# EasyEDA Pro project ProProject_IMUSensorNodes202312.epro, board 6_6_拼板20240123（带编号） (continued)
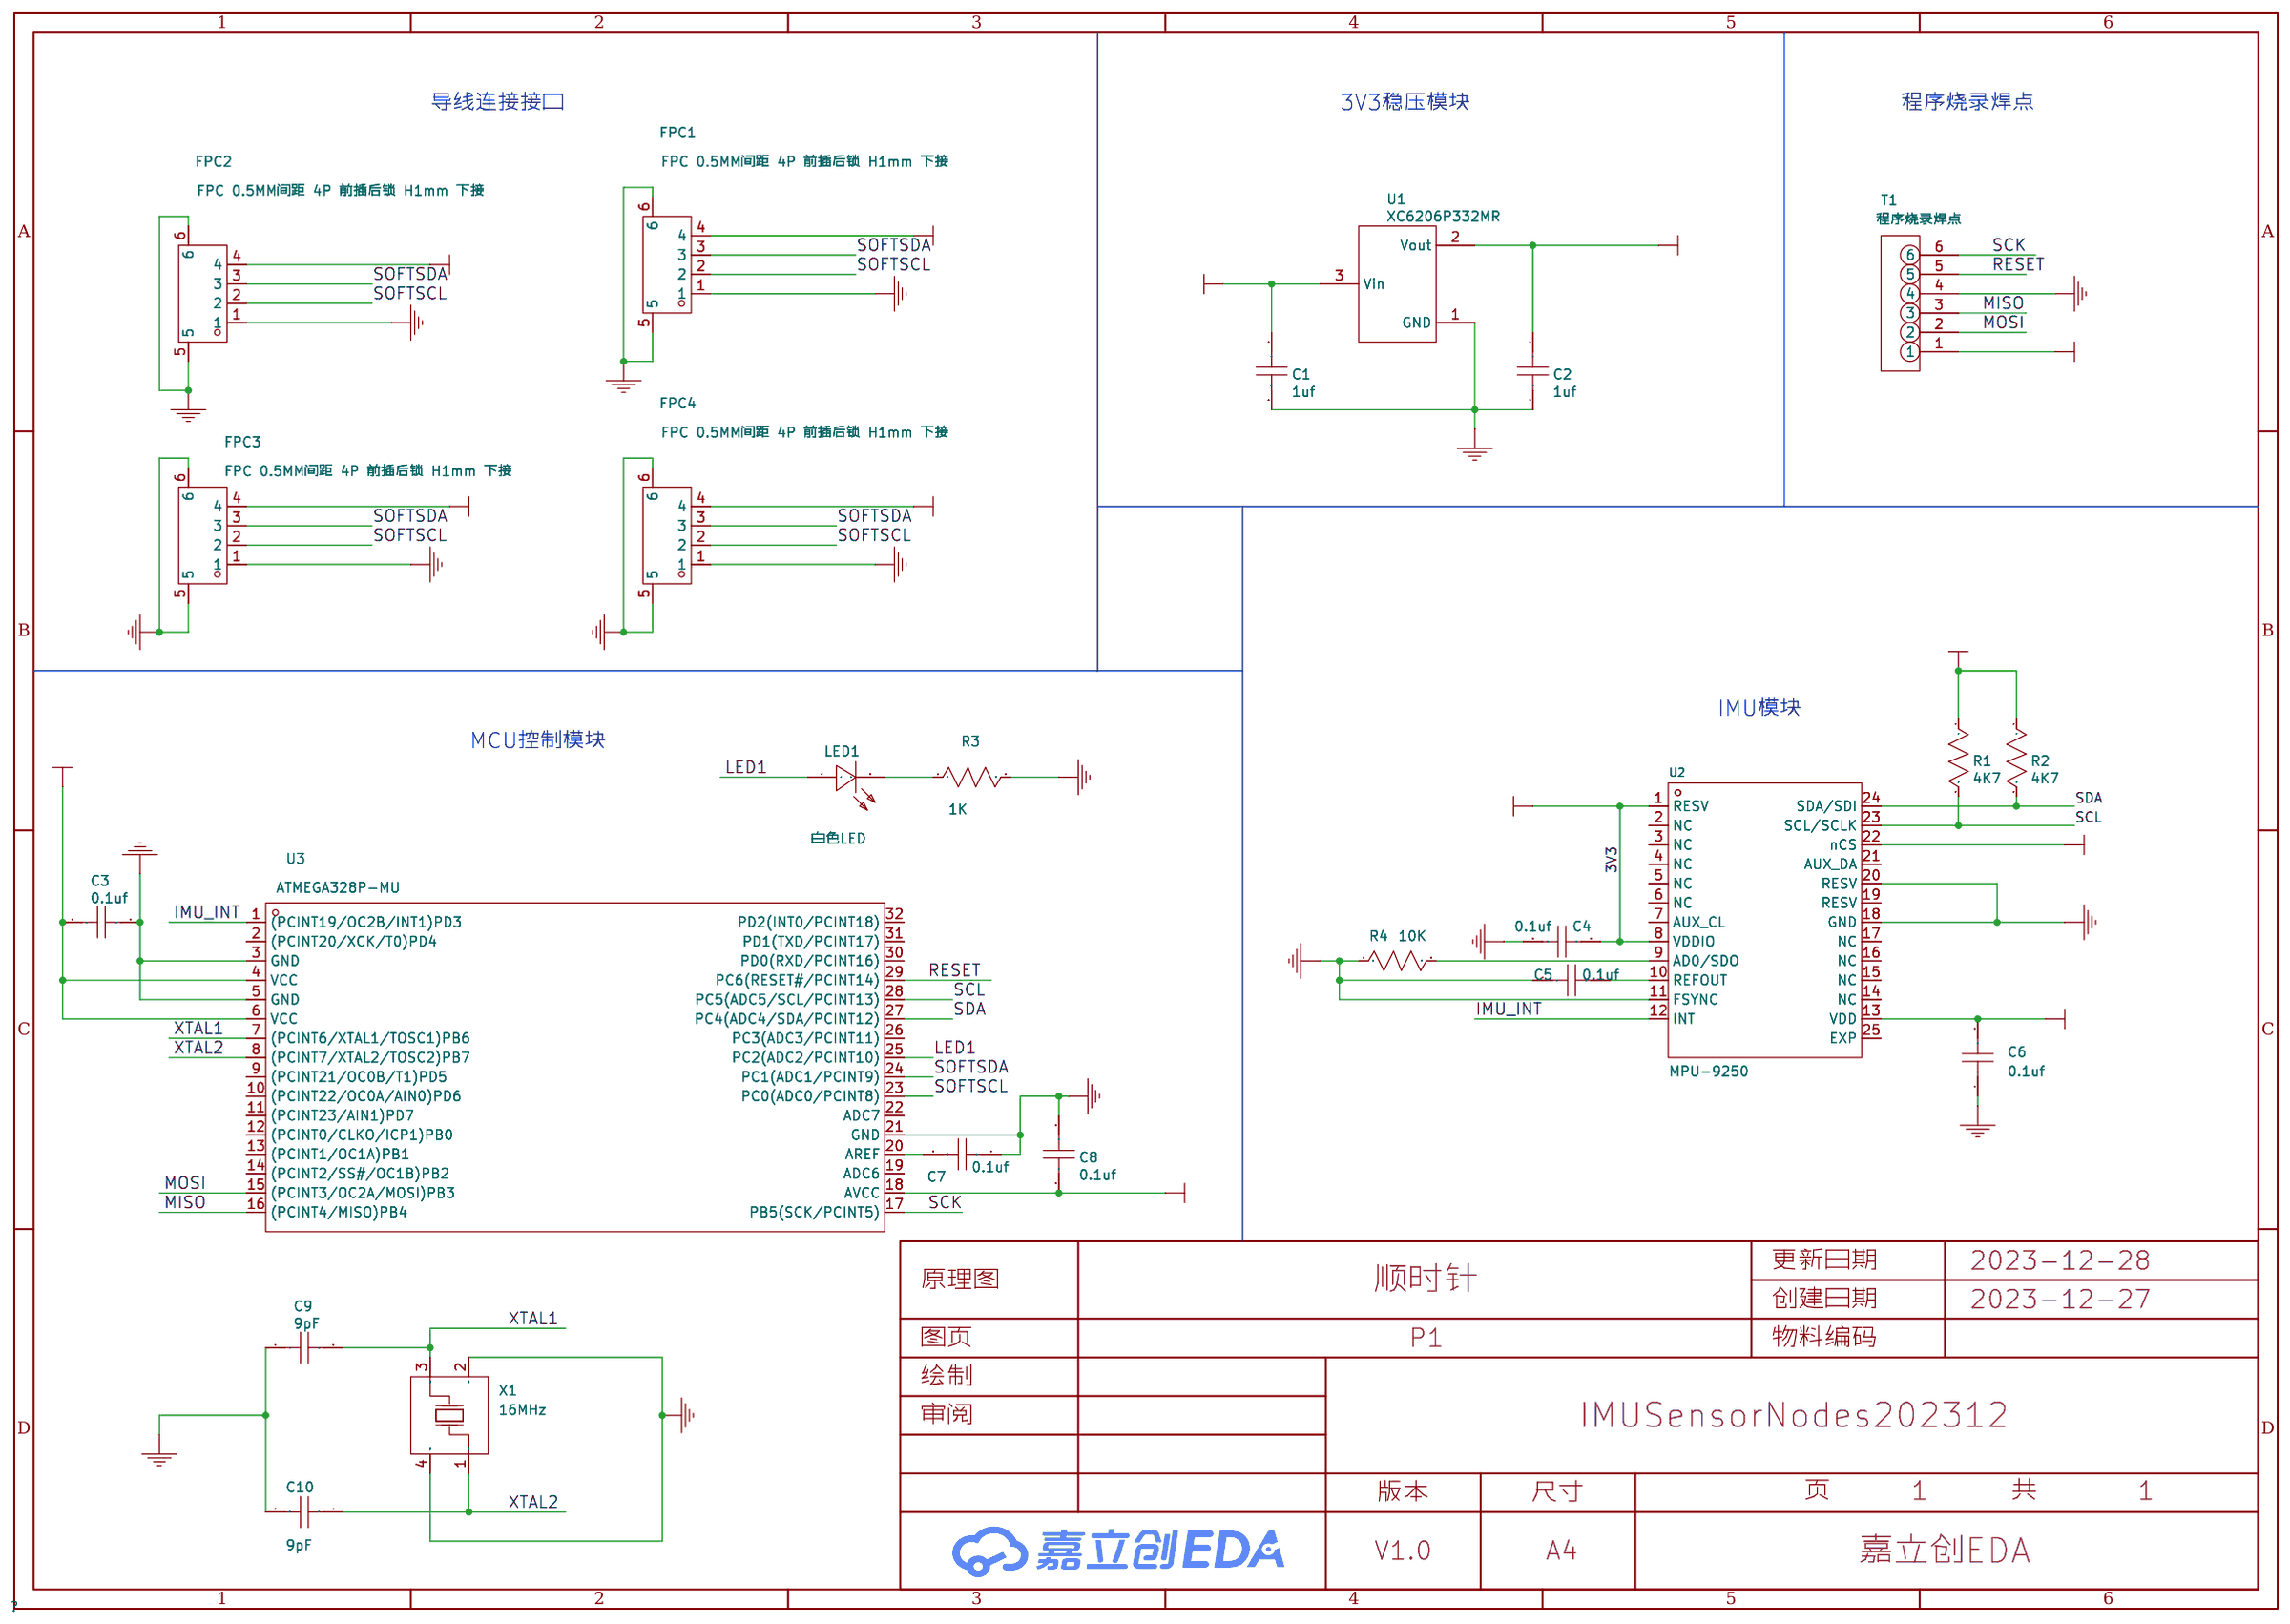
[diagram p0: schematic sheet]
## Routing (per net, layer and track width the routed paths; a pad name or vN(x,y) marks a point on that pad's centre or on a via; arc(x,y) is an arc through that point) (continued)
5V: length 82.8
  Bottom Layer w0.3: 49.43,19.97 49.69,19.97 ; 49.43,19.97 Designator#544.1 49.08,20.37 v1(49.31,20.6) ; 49.43,19.97 arc(49.79,19.82) 49.94,19.46 49.94,18.59 arc(50.08,18.25) v1(50.42,18.11) ; 77.25,47.99 77.25,48.3 Designator#874.3 ; 49.57,76.1 49.94,75.73 49.94,75.42 ; 76.74,74.83 Designator#504.1 76.38,75.24 v1(76.61,75.47) ; 76.74,74.83 76.99,74.83 ; 76.74,74.83 arc(77.1,74.68) 77.25,74.32 77.25,73.46 arc(77.39,73.12) v1(77.73,72.98) ; 76.74,6.25 Designator#618.1 76.38,6.66 v1(76.61,6.89) ; 76.74,6.25 76.99,6.25 ; 76.74,6.25 arc(77.1,6.1) 77.25,5.74 77.25,4.88 arc(77.39,4.54) v1(77.73,4.4) ; 22.13,74.83 22.38,74.83 ; 22.13,74.83 Designator#644.1 21.77,75.24 v1(22,75.47) ; 22.13,74.83 arc(22.49,74.68) 22.64,74.32 22.64,73.46 arc(22.78,73.12) v1(23.12,72.98) ; v1(49.31,75.47) 49.08,75.24 Designator#667.1 49.43,74.83 ; 22.13,19.97 Designator#524.1 21.77,20.37 v1(22,20.6) ; 22.13,19.97 22.38,19.97 ; 22.13,19.97 arc(22.49,19.82) 22.64,19.46 22.64,18.59 arc(22.78,18.25) v1(23.12,18.11) ; 77.25,61.7 77.25,62.01 Designator#868.3 ; 49.43,74.83 49.69,74.83 ; 49.43,74.83 arc(49.79,74.68) 49.94,74.32 49.94,73.46 arc(50.08,73.12) v1(50.42,72.98) ; 49.94,61.7 49.94,62.01 49.57,62.39 ; 22.13,33.68 22.38,33.68 ; 22.13,33.68 Designator#454.1 21.77,34.09 v1(22,34.32) ; 22.13,33.68 arc(22.49,33.54) 22.64,33.18 22.64,32.31 arc(22.78,31.97) v1(23.12,31.83) ; v1(49.31,6.89) 49.08,6.66 Designator#598.1 49.43,6.25 ; 49.43,61.12 Designator#707.1 49.08,61.52 v1(49.31,61.75) ; 49.43,61.12 49.69,61.12 ; 49.43,61.12 arc(49.79,60.97) 49.94,60.61 49.94,59.74 arc(50.08,59.4) v1(50.42,59.26) ; 49.43,47.4 49.69,47.4 ; 49.43,47.4 Designator#767.1 49.08,47.81 v1(49.31,48.03) ; 49.43,47.4 arc(49.79,47.25) 49.94,46.89 49.94,46.02 arc(50.08,45.68) v1(50.42,45.54) ; 22.64,6.84 22.64,7.15 Designator#853.3 ; Designator#845.3 77.25,75.73 77.25,75.42 ; 76.74,61.12 Designator#727.1 76.38,61.52 v1(76.61,61.75) ; 76.74,61.12 76.99,61.12 ; 76.74,61.12 arc(77.1,60.97) 77.25,60.61 77.25,59.74 arc(77.39,59.4) v1(77.73,59.26) ; 49.57,21.24 49.94,20.86 49.94,20.55 ; Designator#847.3 22.64,20.86 22.64,20.55 ; 22.64,34.27 22.64,34.58 Designator#840.3 ; 22.64,75.42 22.64,75.73 Designator#860.3 ; v1(22,6.89) 21.77,6.66 Designator#578.1 22.13,6.25 ; 22.13,47.4 Designator#747.1 21.77,47.81 v1(22,48.03) ; 22.13,47.4 22.38,47.4 ; 22.13,47.4 arc(22.49,47.25) 22.64,46.89 22.64,46.02 arc(22.78,45.68) v1(23.12,45.54) ; 49.94,47.99 49.94,48.3 49.57,48.67 ; v1(49.31,34.32) 49.08,34.09 Designator#474.1 49.43,33.68 ; 22.13,61.12 Designator#687.1 21.77,61.52 v1(22,61.75) ; 22.13,61.12 22.38,61.12 ; 22.13,61.12 arc(22.49,60.97) 22.64,60.61 22.64,59.74 arc(22.78,59.4) v1(23.12,59.26) ; 77.25,6.84 77.25,7.15 Designator#857.3 ; 22.13,6.25 22.38,6.25 ; 22.13,6.25 arc(22.49,6.1) 22.64,5.74 22.64,4.88 arc(22.78,4.54) v1(23.12,4.4) ; 77.25,34.27 77.25,34.58 Designator#844.3 ; 49.57,34.95 49.94,34.58 49.94,34.27 ; 76.74,33.68 76.99,33.68 ; 76.74,33.68 Designator#494.1 76.38,34.09 v1(76.61,34.32) ; 76.74,33.68 arc(77.1,33.54) 77.25,33.18 77.25,32.31 arc(77.39,31.97) v1(77.73,31.83) ; 49.43,33.68 49.69,33.68 ; 49.43,33.68 arc(49.79,33.54) 49.94,33.18 49.94,32.31 arc(50.08,31.97) v1(50.42,31.83) ; 49.57,7.52 49.94,7.15 49.94,6.84 ; 22.64,47.99 22.64,48.3 Designator#870.3 ; 76.74,19.97 76.99,19.97 ; 76.74,19.97 Designator#563.1 76.38,20.37 v1(76.61,20.6) ; 76.74,19.97 arc(77.1,19.82) 77.25,19.46 77.25,18.59 arc(77.39,18.25) v1(77.73,18.11) ; 49.43,6.25 49.69,6.25 ; 49.43,6.25 arc(49.79,6.1) 49.94,5.74 49.94,4.88 arc(50.08,4.54) v1(50.42,4.4) ; Designator#851.3 77.25,20.86 77.25,20.55 ; 76.74,47.4 76.99,47.4 ; 76.74,47.4 Designator#787.1 76.38,47.81 v1(76.61,48.03) ; 76.74,47.4 arc(77.1,47.25) 77.25,46.89 77.25,46.02 arc(77.39,45.68) v1(77.73,45.54) ; Designator#864.3 22.64,62.01 22.64,61.7
  vias: v1(7.64,73.81) v1(7.64,60.1) v1(7.64,46.38) v1(7.64,32.67) v1(7.64,18.95) v1(7.64,5.23) v1(34.95,73.81) v1(34.95,60.1) v1(34.95,46.38) v1(34.95,32.67) v1(34.95,18.95) v1(34.95,5.23) v1(62.25,73.81) v1(62.25,60.1) v1(62.25,46.38) v1(62.25,32.67) v1(62.25,18.95) v1(62.25,5.23)
GND: length 1731.1
  Top Layer w0.127: Designator#111.4 77.48,23.5 78.28,24.3 Designator#111.2 ; Designator#113.2 23.67,38.02 22.87,37.22 Designator#113.4 ; Designator#137.4 50.18,64.65 50.98,65.45 Designator#137.2 ; v1(56.42,63.53) 57.25,63.53 57.69,63.97 57.69,65.69 58.07,66.07 58.69,66.07 Designator#176.6 ; v1(56.42,22.38) 57.25,22.38 57.69,22.82 57.69,24.54 58.07,24.92 58.69,24.92 Designator#235.6 ; v1(7.45,58.19) 7.97,58.7 10.74,58.7 Designator#155.5 ; v1(34.76,30.76) 35.27,31.27 38.04,31.27 Designator#160.5 ; Designator#118.2 78.28,79.17 77.48,78.37 77.48,78.22 ; Designator#139.2 78.28,65.45 77.48,64.65 Designator#139.4 ; 36.46,78.22 36.46,78.37 36.86,78.77 37.01,78.77 v2(37.27,79.02) ; Designator#144.4 63.77,50.94 64.17,51.34 64.32,51.34 v2(64.57,51.59) ; Designator#310.6 31.39,11.21 30.76,11.21 30.38,10.82 30.38,9.11 29.94,8.66 v1(29.11,8.66) ; Designator#125.4 36.46,9.79 36.86,10.19 37.01,10.19 v2(37.27,10.44) ; Designator#138.4 63.77,64.65 64.17,65.05 64.32,65.05 v2(64.57,65.31) ; Designator#20.6 4.08,11.21 3.46,11.21 3.08,10.82 3.08,9.11 2.64,8.66 v1(1.81,8.66) ; v1(29.11,22.38) 29.94,22.38 30.38,22.82 30.38,24.54 30.76,24.92 31.39,24.92 Designator#17.6 ; Designator#152.6 4.08,66.07 3.46,66.07 3.08,65.69 3.08,63.97 2.64,63.53 v1(1.81,63.53) ; v1(34.76,17.04) 35.27,17.56 38.04,17.56 Designator#13.5 ; v1(1.81,77.25) 2.64,77.25 3.08,77.69 3.08,79.4 3.46,79.78 4.08,79.78 Designator#82.6 ; Designator#286.6 4.08,24.92 3.46,24.92 3.08,24.54 3.08,22.82 2.64,22.38 v1(1.81,22.38) ; Designator#110.4 63.77,23.5 64.17,23.91 64.32,23.91 v2(64.57,24.16) ; v1(56.42,77.25) 57.25,77.25 57.69,77.69 57.69,79.4 58.07,79.78 58.69,79.78 Designator#162.6 ; 63.77,78.22 63.77,78.37 64.17,78.77 64.32,78.77 v2(64.57,79.02) ; v1(56.42,36.1) 57.25,36.1 57.69,36.54 57.69,38.26 58.07,38.64 58.69,38.64 Designator#147.6 ; Designator#232.5 10.74,72.42 7.97,72.42 v1(7.45,71.91) ; v1(29.11,77.25) 29.94,77.25 30.38,77.69 30.38,79.4 30.76,79.78 31.39,79.78 Designator#296.6 ; Designator#142.4 36.46,50.94 36.86,51.34 37.01,51.34 v2(37.27,51.59) ; Designator#12.6 58.69,11.21 58.07,11.21 57.69,10.82 57.69,9.11 57.25,8.66 v1(56.42,8.66) ; Designator#170.5 65.35,17.56 62.58,17.56 v1(62.06,17.04) ; v1(62.06,58.19) 62.58,58.7 65.35,58.7 Designator#305.5 ; v2(37.27,24.16) 37.01,23.91 36.86,23.91 36.46,23.5 Designator#121.4 ; v1(62.06,30.76) 62.58,31.27 65.35,31.27 Designator#103.5 ; Designator#143.4 50.18,50.94 50.98,51.74 Designator#143.2 ; Designator#135.2 23.67,65.45 22.87,64.65 Designator#135.4 ; v1(7.45,30.76) 7.97,31.27 10.74,31.27 Designator#95.5 ; Designator#145.2 78.28,51.74 77.48,50.94 Designator#145.4 ; v1(29.11,36.1) 29.94,36.1 30.38,36.54 30.38,38.26 30.76,38.64 31.39,38.64 Designator#226.6 ; Designator#140.4 9.16,50.94 9.56,51.34 9.71,51.34 v2(9.96,51.59) ; v1(29.11,49.81) 29.94,49.81 30.38,50.26 30.38,51.97 30.76,52.35 31.39,52.35 Designator#304.6 ; v1(34.76,3.32) 35.27,3.84 38.04,3.84 Designator#244.5 ; v1(34.76,71.91) 35.27,72.42 38.04,72.42 Designator#288.5 ; Designator#128.4 77.48,9.79 78.28,10.59 Designator#128.2 ; Designator#115.4 50.18,37.22 50.98,38.02 Designator#115.2 ; Designator#136.4 36.46,64.65 36.86,65.05 37.01,65.05 v2(37.27,65.31) ; 9.16,78.22 9.16,78.37 9.56,78.77 9.71,78.77 v2(9.96,79.02) ; v1(62.06,3.32) 62.58,3.84 65.35,3.84 Designator#97.5 ; 50.18,78.22 50.18,78.37 50.98,79.17 Designator#133.2 ; v2(9.96,24.16) 9.71,23.91 9.56,23.91 9.16,23.5 Designator#119.4 ; v2(9.96,10.44) 9.71,10.19 9.56,10.19 9.16,9.79 Designator#123.4 ; Designator#141.4 22.87,50.94 23.67,51.74 Designator#141.2 ; Designator#171.5 38.04,58.7 35.27,58.7 v1(34.76,58.19) ; Designator#116.4 63.77,37.22 64.17,37.62 64.32,37.62 v2(64.57,37.88) ; v2(9.96,65.31) 9.71,65.05 9.56,65.05 9.16,64.65 Designator#134.4 ; Designator#126.2 50.98,10.59 50.18,9.79 Designator#126.4 ; Designator#131.2 23.67,79.17 22.87,78.37 22.87,78.22 ; Designator#120.4 22.87,23.5 23.67,24.3 Designator#120.2 ; v2(37.27,37.88) 37.01,37.62 36.86,37.62 36.46,37.22 Designator#114.4 ; v1(1.81,36.1) 2.64,36.1 3.08,36.54 3.08,38.26 3.46,38.64 4.08,38.64 Designator#91.6 ; Designator#124.2 23.67,10.59 22.87,9.79 Designator#124.4 ; Designator#112.4 9.16,37.22 9.56,37.62 9.71,37.62 v2(9.96,37.88) ; Designator#228.6 4.08,52.35 3.46,52.35 3.08,51.97 3.08,50.26 2.64,49.81 v1(1.81,49.81) ; v1(29.11,63.53) 29.94,63.53 30.38,63.97 30.38,65.69 30.76,66.07 31.39,66.07 Designator#4.6 ; v1(7.45,44.47) 7.97,44.99 10.74,44.99 Designator#83.5 ; v1(62.06,71.91) 62.58,72.42 65.35,72.42 Designator#165.5 ; Designator#287.5 10.74,3.84 7.97,3.84 v1(7.45,3.32) ; Designator#109.5 65.35,44.99 62.58,44.99 v1(62.06,44.47) ; Designator#117.2 78.28,38.02 77.48,37.22 Designator#117.4 ; v2(64.57,10.44) 64.32,10.19 64.17,10.19 63.77,9.79 Designator#127.4 ; v1(56.42,49.81) 57.25,49.81 57.69,50.26 57.69,51.97 58.07,52.35 58.69,52.35 Designator#307.6 ; v1(7.45,17.04) 7.97,17.56 10.74,17.56 Designator#84.5 ; v1(34.76,44.47) 35.27,44.99 38.04,44.99 Designator#146.5 ; Designator#122.4 50.18,23.5 50.98,24.3 Designator#122.2
  Top Layer w0.2: 69.65,46.02 70.88,46.02 v1(71.28,45.62) ; Designator#300.6 24.31,63.15 21.75,63.15 ; 49.05,76.86 51.62,76.86 Designator#166.6 ; 29.24,59.47 29.89,60.11 Designator#167.4 ; 21.75,8.28 24.31,8.28 Designator#5.6 ; 76.36,8.28 78.92,8.28 Designator#14.6 ; Designator.6 51.62,49.43 49.05,49.43 ; 29.24,73.18 29.89,73.83 Designator#220.4 ; Designator#173.4 29.89,46.4 29.24,45.75 ; v1(16.67,73.05) 16.27,73.45 15.03,73.45 ; Designator#229.4 2.58,32.68 1.94,32.04 ; Designator#169.6 24.31,22 21.75,22 ; 76.36,35.72 78.92,35.72 Designator#243.6 ; v1(16.67,59.34) 16.27,59.73 15.03,59.73 ; 42.34,4.87 43.58,4.87 v1(43.97,4.47) ; 29.24,4.6 29.89,5.25 Designator#168.4 ; 42.34,73.45 43.58,73.45 v1(43.97,73.05) ; 1.94,4.6 2.58,5.25 Designator#81.4 ; Designator#100.4 2.58,60.11 1.94,59.47 ; Designator#164.4 57.19,46.4 56.55,45.75 ; 69.65,59.73 70.88,59.73 v1(71.28,59.34) ; 49.05,63.15 51.62,63.15 Designator#297.6 ; 56.55,73.18 57.19,73.83 Designator#9.4 ; 1.94,45.75 2.58,46.4 Designator#282.4 ; v1(43.97,18.19) 43.58,18.58 42.34,18.58 ; 69.65,32.3 70.88,32.3 v1(71.28,31.91) ; 42.34,59.73 43.58,59.73 v1(43.97,59.34) ; Designator#87.4 57.19,32.68 56.55,32.04 ; 21.75,35.72 24.31,35.72 Designator#99.6 ; v1(43.97,45.62) 43.58,46.02 42.34,46.02 ; v1(16.67,18.19) 16.27,18.58 15.03,18.58 ; Designator#104.4 57.19,5.25 56.55,4.6 ; 21.75,76.86 24.31,76.86 Designator#151.6 ; 49.05,35.72 51.62,35.72 Designator#175.6 ; 49.05,8.28 51.62,8.28 Designator#159.6 ; v1(71.28,73.05) 70.88,73.45 69.65,73.45 ; 69.65,4.87 70.88,4.87 v1(71.28,4.47) ; v1(71.28,18.19) 70.88,18.58 69.65,18.58 ; 15.03,46.02 16.27,46.02 v1(16.67,45.62) ; Designator#299.6 78.92,76.86 76.36,76.86 ; v1(43.97,31.91) 43.58,32.3 42.34,32.3 ; 49.05,22 51.62,22 Designator#148.6 ; Designator#2.4 2.58,18.96 1.94,18.32 ; 76.36,49.43 78.92,49.43 Designator#215.6 ; v1(16.67,31.91) 16.27,32.3 15.03,32.3 ; 76.36,63.15 78.92,63.15 Designator#308.6 ; Designator#158.4 29.89,32.68 29.24,32.04 ; 1.94,73.18 2.58,73.83 Designator#289.4 ; 56.55,18.32 57.19,18.96 Designator#106.4 ; Designator#241.4 57.19,60.11 56.55,59.47 ; 29.24,18.32 29.89,18.96 Designator#284.4 ; 15.03,4.87 16.27,4.87 v1(16.67,4.47) ; Designator#157.6 78.92,22 76.36,22 ; Designator#11.6 24.31,49.43 21.75,49.43
  Top Layer w0.22: Designator#100.6 1.54,59.07 1.94,59.47 ; Designator#241.6 56.15,59.07 56.55,59.47 ; 56.55,4.6 56.15,4.2 Designator#104.6 ; 29.24,45.75 28.84,45.35 Designator#173.6 ; Designator#9.6 56.15,72.78 56.55,73.18 ; 29.24,59.47 28.84,59.07 Designator#167.6 ; 29.24,4.6 28.84,4.2 Designator#168.6 ; Designator#164.6 56.15,45.35 56.55,45.75 ; 1.94,45.75 1.54,45.35 Designator#282.6 ; Designator#220.6 28.84,72.78 29.24,73.18 ; 56.55,32.04 56.15,31.64 Designator#87.6 ; Designator#106.6 56.15,17.92 56.55,18.32 ; Designator#158.6 28.84,31.64 29.24,32.04 ; Designator#2.6 1.54,17.92 1.94,18.32 ; 1.94,32.04 1.54,31.64 Designator#229.6 ; 29.24,18.32 28.84,17.92 Designator#284.6 ; Designator#289.6 1.54,72.78 1.94,73.18 ; 1.94,4.6 1.54,4.2 Designator#81.6
  Top Layer w0.254: 21.61,37.07 21.61,36.94 v1(20.73,36.06) 21.08,35.72 21.75,35.72 ; 21.61,37.07 Designator#113.4 ; 21.61,37.07 21.53,37.16 Designator#15.5 21.15,38.89 18.3,38.89 Designator#15.6 17.92,37.96 v1(17.59,37.63) ; v1(72.2,78.78) 72.53,79.1 Designator#18.6 72.91,80.04 75.76,80.04 Designator#18.5 76.14,78.31 76.22,78.22 ; Designator#156.6 14.63,4.46 ; 14.63,4.46 Designator#156.5 14.82,8 v1(15.29,8) ; 14.63,4.46 16.05,5.89 16.05,6.4 16.4,6.75 Designator#156.1 ; Designator#139.4 76.22,64.5 ; 76.22,64.5 76.14,64.59 Designator#239.5 75.76,66.32 72.91,66.32 Designator#239.6 72.53,65.39 v1(72.2,65.06) ; 76.22,64.5 76.22,64.38 v1(75.34,63.5) 75.69,63.15 76.36,63.15 ; 49.05,49.43 48.38,49.43 v1(48.04,49.78) 48.92,50.66 48.92,50.79 ; v1(44.9,37.63) 45.23,37.96 Designator#218.6 45.6,38.89 48.46,38.89 Designator#218.5 48.83,37.16 48.92,37.07 ; Designator#167.5 29.08,63.53 v1(29.11,63.53) ; Designator#204.2 41.81,56.45 arc(41.94,56.16) v1(42.23,56.04) ; 41.94,4.46 43.36,5.89 43.36,6.4 43.71,6.75 Designator#86.1 ; 41.94,4.46 Designator#86.6 ; 41.94,4.46 Designator#86.5 42.12,8 v1(42.6,8) ; 37.84,51.89 38.02,51.89 v1(38.51,51.4) ; 37.84,51.89 37.24,52.48 ; 37.84,51.89 Designator#142.2 37.24,51.91 37.24,52.48 ; Designator#290.6 14.63,73.04 ; 14.63,73.04 Designator#290.5 14.82,76.58 v1(15.29,76.58) ; 14.63,73.04 16.05,74.47 16.05,74.98 16.4,75.33 Designator#290.1 ; 49.05,63.15 48.38,63.15 v1(48.04,63.5) 48.92,64.38 48.92,64.5 ; 9.94,11.33 10.53,10.74 ; 9.94,11.33 9.81,11.46 8.19,11.46 Designator#20.5 ; 9.94,11.33 9.94,10.76 Designator#123.2 10.53,10.74 ; 10.53,10.74 10.72,10.74 v1(11.21,10.25) ; 37.24,79.91 37.84,79.32 ; 37.24,79.91 37.24,79.34 Designator#132.2 37.84,79.32 ; 37.24,79.91 37.12,80.04 35.49,80.04 Designator#296.5 ; 37.84,79.32 38.02,79.32 v1(38.51,78.83) ; 37.24,25.05 37.24,24.47 Designator#121.2 37.84,24.45 ; 37.24,25.05 37.84,24.45 ; 37.24,25.05 37.12,25.17 35.49,25.17 Designator#17.5 ; 69.24,73.04 Designator#92.5 69.43,76.58 v1(69.9,76.58) ; 69.24,73.04 Designator#92.6 ; 69.24,73.04 70.66,74.47 70.66,74.98 71.01,75.33 Designator#92.1 ; Designator#106.5 56.38,22.38 v1(56.42,22.38) ; 69.24,59.33 Designator#237.5 69.43,62.86 v1(69.9,62.86) ; 69.24,59.33 Designator#237.6 ; 69.24,59.33 70.66,60.75 70.66,61.26 71.01,61.61 Designator#237.1 ; Designator#2.5 1.77,22.38 v1(1.81,22.38) ; v1(38.51,65.11) 38.02,65.6 37.84,65.6 ; 14.63,45.61 16.05,47.03 16.05,47.55 16.4,47.9 Designator#283.1 ; 14.63,45.61 Designator#283.5 14.82,49.15 v1(15.29,49.15) ; 14.63,45.61 Designator#283.6 ; Designator#164.5 56.38,49.81 v1(56.42,49.81) ; 10.53,24.45 10.72,24.45 v1(11.21,23.96) ; 10.53,24.45 Designator#119.2 9.94,24.47 9.94,25.05 ; 10.53,24.45 9.94,25.05 ; Designator#187.2 41.81,15.31 arc(41.94,15.01) v1(42.23,14.89) ; Designator#162.5 62.79,80.04 64.42,80.04 64.55,79.91 ; 65.14,38.17 Designator#116.2 64.55,38.19 64.55,38.76 ; 65.14,38.17 64.55,38.76 ; 65.14,38.17 65.33,38.17 v1(65.82,37.68) ; Designator#298.6 14.63,18.18 ; 14.63,18.18 16.05,19.6 16.05,20.12 16.4,20.46 Designator#298.1 ; 14.63,18.18 Designator#298.5 14.82,21.71 v1(15.29,21.71) ; 76.22,9.64 76.22,9.51 v1(75.34,8.63) 75.69,8.28 76.36,8.28 ; 76.22,9.64 Designator#128.4 ; 76.22,9.64 76.14,9.73 Designator#6.5 75.76,11.46 72.91,11.46 Designator#6.6 72.53,10.52 v1(72.2,10.19) ; Designator#158.5 29.08,36.1 v1(29.11,36.1) ; 9.94,66.2 9.94,65.62 Designator#134.2 10.53,65.6 ; 9.94,66.2 10.53,65.6 ; 9.94,66.2 9.81,66.32 8.19,66.32 Designator#152.5 ; Designator#9.5 56.38,77.25 v1(56.42,77.25) ; v1(29.11,22.38) 29.08,22.38 Designator#284.5 ; 9.94,52.48 9.94,51.91 Designator#140.2 10.53,51.89 ; 9.94,52.48 10.53,51.89 ; 9.94,52.48 9.81,52.61 8.19,52.61 Designator#228.5 ; 37.24,11.33 37.12,11.46 35.49,11.46 Designator#310.5 ; 37.24,11.33 37.24,10.76 Designator#125.2 37.84,10.74 ; 37.24,11.33 37.84,10.74 ; v1(56.42,36.1) 56.38,36.1 Designator#87.5 ; Designator#312.6 41.94,18.18 ; 41.94,18.18 Designator#312.5 42.12,21.71 v1(42.6,21.71) ; 41.94,18.18 43.36,19.6 43.36,20.12 43.71,20.46 Designator#312.1 ; 21.61,64.5 21.53,64.59 Designator#225.5 21.15,66.32 18.3,66.32 Designator#225.6 17.92,65.39 v1(17.59,65.06) ; 21.61,64.5 21.61,64.38 v1(20.73,63.5) 21.08,63.15 21.75,63.15 ; 21.61,64.5 Designator#135.4 ; 64.55,38.76 64.42,38.89 62.79,38.89 Designator#147.5 ; 37.84,24.45 38.02,24.45 v1(38.51,23.96) ; v1(29.11,49.81) 29.08,49.81 Designator#173.5 ; 77.48,78.22 76.22,78.22 ; 76.22,78.22 76.22,78.09 v1(75.34,77.21) 75.69,76.86 76.36,76.86 ; 48.92,64.5 Designator#137.4 ; 48.92,64.5 48.83,64.59 Designator#309.5 48.46,66.32 45.6,66.32 Designator#309.6 45.23,65.39 v1(44.9,65.06) ; v1(65.82,10.25) 65.33,10.74 65.14,10.74 ; 41.94,59.33 43.36,60.75 43.36,61.26 43.71,61.61 Designator#234.1 ; 41.94,59.33 Designator#234.5 42.12,62.86 v1(42.6,62.86) ; 41.94,59.33 Designator#234.6 ; 48.92,78.22 48.83,78.31 Designator#291.5 48.46,80.04 45.6,80.04 Designator#291.6 45.23,79.1 v1(44.9,78.78) ; 48.92,78.22 48.92,78.09 v1(48.04,77.21) 48.38,76.86 49.05,76.86 ; 48.92,78.22 50.18,78.22 ; 65.14,24.45 Designator#110.2 64.55,24.47 64.55,25.05 ; 65.14,24.45 64.55,25.05 ; 65.14,24.45 65.33,24.45 v1(65.82,23.96) ; 10.53,79.32 10.72,79.32 v1(11.21,78.83) ; 10.53,79.32 9.94,79.91 ; 10.53,79.32 Designator#129.2 9.94,79.34 9.94,79.91 ; 49.05,8.28 48.38,8.28 v1(48.04,8.63) 48.92,9.51 48.92,9.64 ; Designator#185.2 14.51,15.31 arc(14.63,15.01) v1(14.93,14.89) ; v1(1.81,36.1) 1.77,36.1 Designator#229.5 ; v1(15.29,35.43) 14.82,35.43 Designator#94.5 14.63,31.89 ; 37.84,38.17 38.02,38.17 v1(38.51,37.68) ; 37.84,38.17 37.24,38.76 ; 37.84,38.17 Designator#114.2 37.24,38.19 37.24,38.76 ; v1(65.82,65.11) 65.33,65.6 65.14,65.6 ; Designator#219.1 43.71,34.18 43.36,33.83 43.36,33.32 41.94,31.89 ; 65.14,65.6 64.55,66.2 ; 65.14,65.6 Designator#138.2 64.55,65.62 64.55,66.2 ; Designator#206.2 69.12,56.45 arc(69.24,56.16) v1(69.54,56.04) ; v1(44.9,10.19) 45.23,10.52 Designator#231.6 45.6,11.46 48.46,11.46 Designator#231.5 48.83,9.73 48.92,9.64 ; 48.92,9.64 Designator#126.4 ; 76.36,49.43 75.69,49.43 v1(75.34,49.78) 76.22,50.66 76.22,50.79 ; 41.94,73.04 Designator#294.5 42.12,76.58 v1(42.6,76.58) ; 41.94,73.04 43.36,74.47 43.36,74.98 43.71,75.33 Designator#294.1 ; 41.94,73.04 Designator#294.6 ; v1(11.21,51.4) 10.72,51.89 10.53,51.89 ; 64.55,25.05 64.42,25.17 62.79,25.17 Designator#235.5 ; 21.61,78.22 21.61,78.09 v1(20.73,77.21) 21.08,76.86 21.75,76.86 ; 21.61,78.22 21.53,78.31 Designator#302.5 21.15,80.04 18.3,80.04 Designator#302.6 17.92,79.1 v1(17.59,78.78) ; 21.61,78.22 22.87,78.22 ; 14.63,59.33 Designator#3.5 14.82,62.86 v1(15.29,62.86) ; 14.63,59.33 Designator#3.6 ; 14.63,59.33 16.05,60.75 16.05,61.26 16.4,61.61 Designator#3.1 ; 49.05,22 48.38,22 v1(48.04,22.35) 48.92,23.23 48.92,23.36 ; v1(1.81,8.66) 1.77,8.66 Designator#81.5 ; 64.55,11.33 64.55,10.76 Designator#127.2 65.14,10.74 ; 64.55,11.33 65.14,10.74 ; 64.55,11.33 64.42,11.46 62.79,11.46 Designator#12.5 ; 21.61,50.79 21.53,50.87 Designator#214.5 21.15,52.61 18.3,52.61 Designator#214.6 17.92,51.67 v1(17.59,51.34) ; 21.61,50.79 21.61,50.66 v1(20.73,49.78) 21.08,49.43 21.75,49.43 ; 21.61,50.79 Designator#141.4 ; Designator#100.5 1.77,63.53 v1(1.81,63.53) ; 21.61,23.36 21.53,23.44 Designator#303.5 21.15,25.17 18.3,25.17 Designator#303.6 17.92,24.24 v1(17.59,23.91) ; 21.61,23.36 Designator#120.4 ; 21.61,23.36 21.61,23.23 v1(20.73,22.35) 21.08,22 21.75,22 ; v1(72.2,23.91) 72.53,24.24 Designator#238.6 72.91,25.17 75.76,25.17 Designator#238.5 76.14,23.44 76.22,23.36 ; 48.92,37.07 48.92,36.94 v1(48.04,36.06) 48.38,35.72 49.05,35.72 ; 48.92,37.07 Designator#115.4 ; v1(1.81,49.81) 1.77,49.81 Designator#282.5 ; 37.84,65.6 Designator#136.2 37.24,65.62 37.24,66.2 ; 37.84,65.6 37.24,66.2 ; Designator#150.6 69.24,31.89 ; 69.24,31.89 70.66,33.32 70.66,33.83 71.01,34.18 Designator#150.1 ; 69.24,31.89 Designator#150.5 69.43,35.43 v1(69.9,35.43) ; 9.94,38.76 10.53,38.17 ; 9.94,38.76 9.81,38.89 8.19,38.89 Designator#91.5 ; 9.94,38.76 9.94,38.19 Designator#112.2 10.53,38.17 ; 10.53,38.17 10.72,38.17 v1(11.21,37.68) ; Designator#143.4 48.92,50.79 ; 48.92,50.79 48.83,50.87 Designator#230.5 48.46,52.61 45.6,52.61 Designator#230.6 45.23,51.67 v1(44.9,51.34) ; Designator#212.2 69.12,42.74 arc(69.24,42.44) v1(69.54,42.32) ; Designator#307.5 62.79,52.61 64.42,52.61 64.55,52.48 ; 14.63,31.89 16.05,33.32 16.05,33.83 16.4,34.18 Designator#94.1 ; 14.63,31.89 Designator#94.6 ; 37.24,38.76 37.12,38.89 35.49,38.89 Designator#226.5 ; 69.24,45.61 70.66,47.03 70.66,47.55 71.01,47.9 Designator#292.1 ; 69.24,45.61 Designator#292.6 ; 69.24,45.61 Designator#292.5 69.43,49.15 v1(69.9,49.15) ; Designator#168.5 29.08,8.66 v1(29.11,8.66) ; 21.61,9.64 21.53,9.73 Designator#301.5 21.15,11.46 18.3,11.46 Designator#301.6 17.92,10.52 v1(17.59,10.19) ; 21.61,9.64 21.61,9.51 v1(20.73,8.63) 21.08,8.28 21.75,8.28 ; 21.61,9.64 Designator#124.4 ; 41.94,31.89 Designator#219.6 ; 41.94,31.89 Designator#219.5 42.12,35.43 v1(42.6,35.43) ; Designator#210.2 41.81,42.74 arc(41.94,42.44) v1(42.23,42.32) ; Designator#289.5 1.77,77.25 v1(1.81,77.25) ; 37.84,10.74 38.02,10.74 v1(38.51,10.25) ; v1(65.82,78.83) 65.33,79.32 65.14,79.32 ; 37.24,52.48 37.12,52.61 35.49,52.61 Designator#304.5 ; Designator#233.1 43.71,47.9 43.36,47.55 43.36,47.03 41.94,45.61 ; Designator#217.6 69.24,18.18 ; 69.24,18.18 70.66,19.6 70.66,20.12 71.01,20.46 Designator#217.1 ; 69.24,18.18 Designator#217.5 69.43,21.71 v1(69.9,21.71) ; v1(56.42,63.53) 56.38,63.53 Designator#241.5 ; 37.24,66.2 37.12,66.32 35.49,66.32 Designator#4.5 ; 76.22,50.79 76.14,50.87 Designator#311.5 75.76,52.61 72.91,52.61 Designator#311.6 72.53,51.67 v1(72.2,51.34) ; 76.22,50.79 Designator#145.4 ; Designator#104.5 56.38,8.66 v1(56.42,8.66) ; 41.94,45.61 Designator#233.5 42.12,49.15 v1(42.6,49.15) ; 41.94,45.61 Designator#233.6 ; 76.22,37.07 76.22,36.94 v1(75.34,36.06) 75.69,35.72 76.36,35.72 ; 76.22,37.07 Designator#117.4 ; 76.22,37.07 76.14,37.16 Designator#93.5 75.76,38.89 72.91,38.89 Designator#93.6 72.53,37.96 v1(72.2,37.63) ; 64.55,66.2 64.42,66.32 62.79,66.32 Designator#176.5 ; Designator#200.2 41.81,70.17 arc(41.94,69.87) v1(42.23,69.75) ; Designator#193.2 41.81,1.59 arc(41.94,1.29) v1(42.23,1.17) ; 64.55,79.91 64.55,79.34 Designator#130.2 65.14,79.32 ; 64.55,79.91 65.14,79.32 ; 65.14,51.89 65.33,51.89 v1(65.82,51.4) ; 65.14,51.89 Designator#144.2 64.55,51.91 64.55,52.48 ; 65.14,51.89 64.55,52.48 ; 9.94,79.91 9.81,80.04 8.19,80.04 Designator#82.5 ; Designator#189.2 69.12,15.31 arc(69.24,15.01) v1(69.54,14.89) ; Designator#208.2 14.51,42.74 arc(14.63,42.44) v1(14.93,42.32) ; 10.53,65.6 10.72,65.6 v1(11.21,65.11) ; Designator#198.2 14.51,70.17 arc(14.63,69.87) v1(14.93,69.75) ; Designator#182.2 69.12,29.02 arc(69.24,28.73) v1(69.54,28.6) ; Designator#183.2 69.12,70.17 arc(69.24,69.87) v1(69.54,69.75) ; Designator#111.4 76.22,23.36 ; 76.22,23.36 76.22,23.23 v1(75.34,22.35) 75.69,22 76.36,22 ; Designator#178.2 14.51,29.02 arc(14.63,28.73) v1(14.93,28.6) ; Designator#180.2 41.81,29.02 arc(41.94,28.73) v1(42.23,28.6) ; 9.94,25.05 9.81,25.17 8.19,25.17 Designator#286.5 ; Designator#191.2 14.51,1.59 arc(14.63,1.29) v1(14.93,1.17) ; Designator#122.4 48.92,23.36 ; 48.92,23.36 48.83,23.44 Designator#221.5 48.46,25.17 45.6,25.17 Designator#221.6 45.23,24.24 v1(44.9,23.91) ; Designator#202.2 14.51,56.45 arc(14.63,56.16) v1(14.93,56.04) ; v1(69.9,8) 69.43,8 Designator#98.5 69.24,4.46 ; v1(29.11,77.25) 29.08,77.25 Designator#220.5 ; Designator#98.1 71.01,6.75 70.66,6.4 70.66,5.89 69.24,4.46 ; 69.24,4.46 Designator#98.6 ; Designator#195.2 69.12,1.59 arc(69.24,1.29) v1(69.54,1.17)
  Top Layer w0.4: Designator#289.5 Designator#289.6 ; Designator#282.5 Designator#282.6 ; Designator#308.5 Designator#308.6 79.41,65.19 v1(79.53,65.31) ; v1(79.53,51.59) 79.41,51.47 Designator#215.6 Designator#215.5 ; v1(52.23,10.44) 52.11,10.32 Designator#159.6 Designator#159.5 ; Designator#148.5 Designator#148.6 52.11,24.04 v1(52.23,24.16) ; Designator#99.5 Designator#99.6 24.8,37.75 v1(24.92,37.88) ; v1(79.53,10.44) 79.41,10.32 Designator#14.6 Designator#14.5 ; Designator#100.5 Designator#100.6 ; Designator#2.5 Designator#2.6 ; v1(52.23,37.88) 52.11,37.75 Designator#175.6 Designator#175.5 ; Designator#300.5 Designator#300.6 24.8,65.19 v1(24.92,65.31) ; Designator#81.5 Designator#81.6 ; Designator#168.5 Designator#168.6 ; Designator#169.5 Designator#169.6 24.8,24.04 v1(24.92,24.16) ; v1(24.92,51.59) 24.8,51.47 Designator#11.6 Designator#11.5 ; v1(79.53,37.88) 79.41,37.75 Designator#243.6 Designator#243.5 ; v1(79.53,79.02) 79.41,78.9 Designator#299.6 Designator#299.5 ; Designator#158.5 Designator#158.6 ; v1(24.92,10.44) 24.8,10.32 Designator#5.6 Designator#5.5 ; v1(24.92,79.02) 24.8,78.9 Designator#151.6 Designator#151.5 ; Designator#220.5 Designator#220.6 ; Designator#166.5 Designator#166.6 52.11,78.9 v1(52.23,79.02) ; Designator.5 Designator.6 52.11,51.47 v1(52.23,51.59) ; Designator#297.5 Designator#297.6 52.11,65.19 v1(52.23,65.31) ; Designator#157.5 Designator#157.6 79.41,24.04 v1(79.53,24.16) ; Designator#173.5 Designator#173.6 ; Designator#106.5 Designator#106.6 ; Designator#241.5 Designator#241.6 ; Designator#87.5 Designator#87.6 ; Designator#9.5 Designator#9.6 ; Designator#164.5 Designator#164.6 ; Designator#229.5 Designator#229.6 ; Designator#104.5 Designator#104.6 ; Designator#284.5 Designator#284.6 ; Designator#167.5 Designator#167.6
  Bottom Layer w0.127: Designator#731.2 78.16,64.29 78.16,65.56 ; Designator#594.2 35.59,10.95 35.81,11.17 36.48,11.17 36.76,10.89 Designator#593.1 ; 78.16,79.28 78.16,78.01 Designator#508.2 ; 50.58,79.53 50.58,79.4 50.7,79.28 ; 78,79.28 77.88,79.4 77.88,79.53 ; Designator#743.2 8.29,52.1 8.5,52.31 9.17,52.31 9.45,52.04 Designator#742.1 ; Designator#634.2 8.29,79.53 8.5,79.75 9.17,79.75 9.45,79.47 Designator#633.1 ; Designator#791.2 78.16,50.58 78.16,51.84 ; Designator#449.1 9.45,38.32 9.17,38.6 8.5,38.6 8.29,38.38 Designator#450.2 ; 50.85,24.41 50.85,23.14 Designator#549.2 ; 23.55,24.41 23.55,23.14 Designator#528.2 ; 50.85,38.13 50.85,36.86 Designator#478.2 ; 23.27,65.81 23.27,65.68 23.39,65.56 ; Designator#582.2 23.55,9.43 23.55,10.7 ; 23.39,24.41 23.27,24.53 23.27,24.67 ; Designator#469.1 36.76,38.32 36.48,38.6 35.81,38.6 35.59,38.38 Designator#470.2 ; Designator#548.2 62.9,79.53 63.11,79.75 63.78,79.75 64.06,79.47 Designator#648.1 ; 50.58,38.38 50.58,38.25 50.7,38.13 ; Designator#703.2 35.59,65.81 35.81,66.03 36.48,66.03 36.76,65.75 Designator#702.1 ; Designator#783.2 62.9,52.1 63.11,52.31 63.78,52.31 64.06,52.04 Designator#782.1 ; Designator#671.2 50.85,78.01 50.85,79.28 ; Designator#559.2 62.9,24.67 63.11,24.88 63.78,24.88 64.06,24.61 Designator#442.1 ; Designator#649.2 23.55,78.01 23.55,79.28 ; 78,24.41 77.88,24.53 77.88,24.67 ; Designator#662.1 36.76,79.47 36.48,79.75 35.81,79.75 35.59,79.53 Designator#663.2 ; Designator#691.2 23.55,64.29 23.55,65.56 ; Designator#711.2 50.85,64.29 50.85,65.56 ; 78.16,10.7 78.16,9.43 Designator#622.2 ; 77.88,10.95 77.88,10.82 78,10.7 ; Designator#613.1 64.06,10.89 63.78,11.17 63.11,11.17 62.9,10.95 Designator#614.2 ; 78.16,24.41 78.16,23.14 Designator#443.2 ; Designator#489.1 64.06,38.32 63.78,38.6 63.11,38.6 62.9,38.38 Designator#490.2 ; 23.27,10.95 23.27,10.82 23.39,10.7 ; 77.88,52.1 77.88,51.97 78,51.84 ; Designator#573.1 9.45,10.89 9.17,11.17 8.5,11.17 8.29,10.95 Designator#574.2 ; 23.39,79.28 23.27,79.4 23.27,79.53 ; Designator#771.2 50.85,50.58 50.85,51.84 ; 23.55,51.84 23.55,50.58 Designator#751.2 ; 78.16,38.13 78.16,36.86 Designator#498.2 ; 23.39,51.84 23.27,51.97 23.27,52.1 ; 50.85,10.7 50.85,9.43 Designator#602.2 ; 78,65.56 77.88,65.68 77.88,65.81 ; 50.7,51.84 50.58,51.97 50.58,52.1 ; 50.7,10.7 50.58,10.82 50.58,10.95 ; Designator#762.1 36.76,52.04 36.48,52.31 35.81,52.31 35.59,52.1 Designator#763.2 ; Designator#458.2 23.55,36.86 23.55,38.13 ; 23.39,38.13 23.27,38.25 23.27,38.38 ; 50.58,24.67 50.58,24.53 50.7,24.41 ; Designator#519.1 9.45,24.61 9.17,24.88 8.5,24.88 8.29,24.67 Designator#520.2 ; Designator#682.1 9.45,65.75 9.17,66.03 8.5,66.03 8.29,65.81 Designator#683.2 ; 50.7,65.56 50.58,65.68 50.58,65.81 ; Designator#723.2 62.9,65.81 63.11,66.03 63.78,66.03 64.06,65.75 Designator#722.1 ; Designator#540.2 35.59,24.67 35.81,24.88 36.48,24.88 36.76,24.61 Designator#539.1 ; 77.88,38.38 77.88,38.25 78,38.13